# EasyEDA Pro project 智能车.eprj, board PCB5
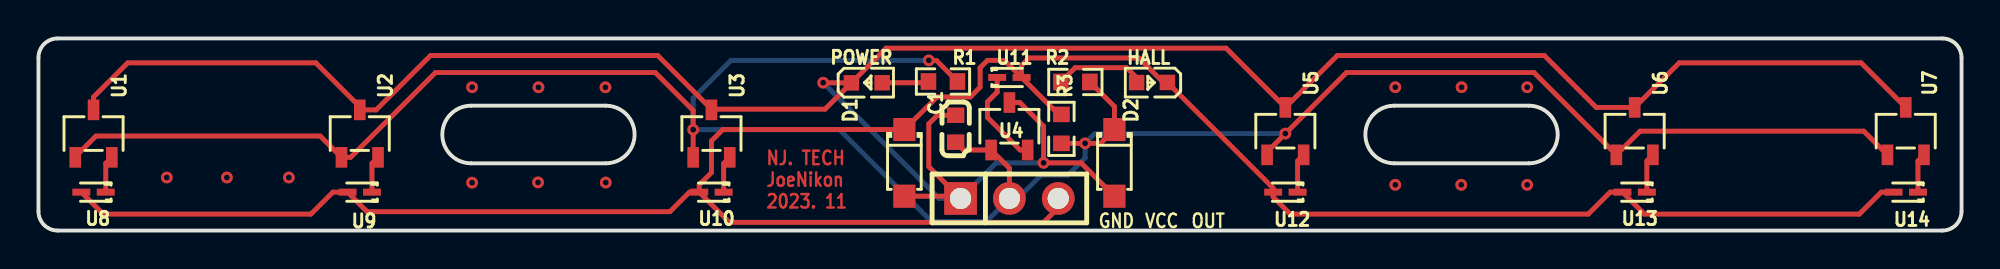
[diagram p16: board, top side]
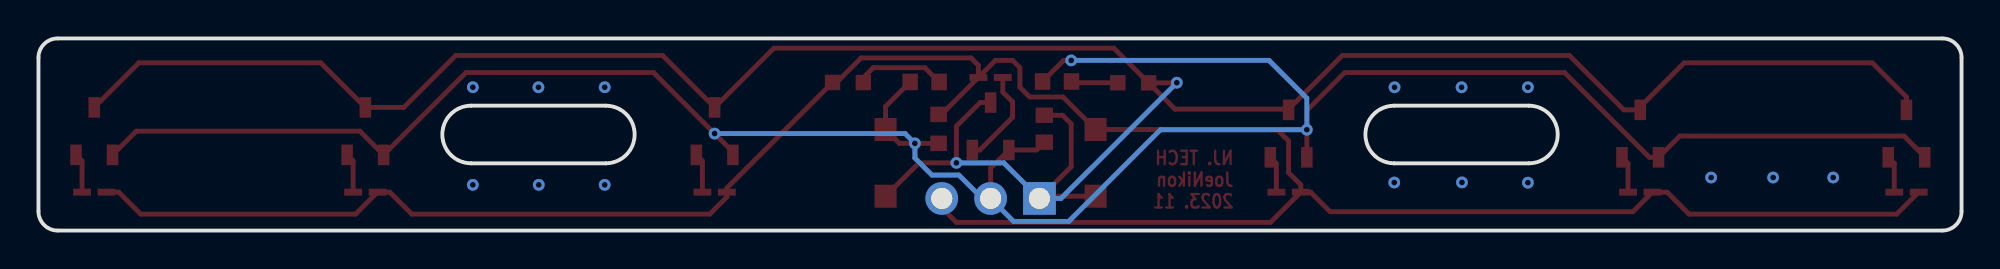
[diagram p17: board, bottom side, seen from below]

Outline 100 x 10 mm; copper layers: Top Layer, Bottom Layer. Coordinates in mm from the lower left corner of the outline.
Outline path: 0,9 0,1 arc(0.29,0.29) 1,0 99,0 arc(99.71,0.29) 100,1 100,9 arc(99.71,9.71) 99,10 1,10 arc(0.29,9.71) 0,9 ; 22.5,3.5 arc(21,5) 22.5,6.5 29.5,6.5 arc(31,5) 29.5,3.5 22.5,3.5 ; 70.5,6.5 77.5,6.5 arc(79,5) 77.5,3.5 70.5,3.5 arc(69,5) 70.5,6.5
Stack: Top Layer 0.035mm / Dielectric1 1.51mm FR4 er 4.5 / Bottom Layer 0.035mm

## Design rules (mm)
template: JLCPCB Capability(Two Layers Board)
spacing copperThickness1oz (default): track to track 0.102, other pairs 0.152 to 0.3
spacing copperThickness2oz: track to track 0.203, other pairs 0.152 to 0.3
track width copperThickness1oz (default): min 0.127, default 0.254, max 2.54
track width copperThickness2oz: min 0.203, default 0.254, max 2.54
differential pair differentialPair (default): width min 0.127, default 0.254, max 2.54; gap min 0.152, default 0.152
via viaSize (default): diameter min 0.5, default 0.61, max 10; hole min 0.3, default 0.305, max 6.3

## Placement (name value [footprint] x y rotation side)
C1  100nF  [C0603]  47.69 5.3 90 top
D1  SMF5.0A  [SOD-123FL_L2.7-W1.8-LS3.7-RD]  45.03 3.52 270 top
D2  SMF5.0A  [SOD-123FL_L2.7-W1.8-LS3.7-RD]  55.95 3.52 270 top
H1  -  [HDR-TH_3P-P2.54-V-M]  50.49 1.67 0 top
HALL  -  [LED_0603]  57.85 7.7 180 top
POWER  -  [LED_0603]  43.12 7.7 0 top
R1  4.7K  [R0603]  47.03 7.76 0 top
R2  4.7K  [R0603]  53.92 7.73 0 top
R3  10K  [R0603]  53.19 5.29 270 top
U1  DH553  [SOT-23-3_L2.9-W1.6-P1.90-LS2.8-BR]  2.86 5.05 270 top
U2  DH553  [SOT-23-3_L2.9-W1.6-P1.90-LS2.8-BR]  16.71 5.05 270 top
U3  DH553  [SOT-23-3_L2.9-W1.6-P1.90-LS2.8-BR]  35 5.05 270 top
U4  DH553  [SOT-23-3_L2.9-W1.6-P1.90-LS2.8-BR]  50.49 5.43 270 top
U5  DH553  [SOT-23-3_L2.9-W1.6-P1.90-LS2.8-BR]  64.84 5.17 270 top
U6  DH553  [SOT-23-3_L2.9-W1.6-P1.90-LS2.8-BR]  83 5.17 270 top
U7  DH553  [SOT-23-3_L2.9-W1.6-P1.90-LS2.8-BR]  97.1 5.17 270 top
U8  RB521S-30  [SOD-523_L1.2-W0.8-LS1.6-RD]  2.86 2 180 top
U9  RB521S-30  [SOD-523_L1.2-W0.8-LS1.6-RD]  16.71 2 180 top
U10  RB521S-30  [SOD-523_L1.2-W0.8-LS1.6-RD]  35 2 180 top
U11  RB521S-30  [SOD-523_L1.2-W0.8-LS1.6-RD]  50.49 7.97 0 top
U12  RB521S-30  [SOD-523_L1.2-W0.8-LS1.6-RD]  64.84 2 180 top
U13  RB521S-30  [SOD-523_L1.2-W0.8-LS1.6-RD]  83 2 180 top
U14  RB521S-30  [SOD-523_L1.2-W0.8-LS1.6-RD]  97.1 2 180 top

## Footprints (pads in the part's own frame, mm; a bottom-side part is the same pattern mirrored in y, then rotated)
C0603
  rect 0.8x0.9 smd: 1(-0.7,0) 2(0.7,0)
HDR-TH_3P-P2.54-V-M
  rect 1.7x1.7 hole 1.1: 1(-2.54,0)
  round 1.7 hole 1.1: 2(0,0) 3(2.54,0)
LED_0603
  rect 0.8x0.8 smd: 1(-0.851,-0.01) 2(0.75,-0.005)
R0603
  rect 0.806x0.864 smd: 1(-0.753,0) 2(0.753,0)
SOD-123FL_L2.7-W1.8-LS3.7-RD
  rect 1.2x1.15 smd: 1(-1.735,0) 2(1.735,0)
SOD-523_L1.2-W0.8-LS1.6-RD
  rect 0.93x0.36 smd: 1(-0.635,0) 2(0.635,0)
SOT-23-3_L2.9-W1.6-P1.90-LS2.8-BR
  rect 1.07x0.6 smd: 1(1.235,-0.95) 2(1.235,0.95) 3(-1.235,0)

## Nets
As in the schematic.

## Via types
v1: diameter 0.61, hole 0.305, Top Layer to Bottom Layer, 21 vias

## Routing (per net, layer and track width the routed paths; a pad name or vN(x,y) marks a point on that pad's centre or on a via; arc(x,y) is an arc through that point)
GND: length 139.6
  Top Layer w0.254: D2.2 54.22,3.52 v1(52.27,3.52) 52.27,5.43 51.03,6.66 U4.3 ; 35,6.32 32.2,9.11 20.39,9.11 17.56,6.28 U2.3 16.71,6.44 14.42,8.73 4.64,8.73 2.86,6.95 U1.3 ; 35,6.32 40.9,6.32 POWER.1 ; 35,6.32 U3.3 ; POWER.1 40.81,7.69 v1(40.81,7.7) ; POWER.1 44.08,9.49 61.76,9.49 U5.3 67.54,9.11 78.3,9.11 81,6.41 U6.3 85.32,8.73 94.78,8.73 U7.3 ; C1.2 46.74,6 46.3,5.56 46.3,3.32 47.83,1.79 ; 47.83,1.79 H1.1 ; 47.83,1.79 D1.2
  Bottom Layer w0.254: v1(52.27,3.52) 49.8,3.52 H1.1 46.83,1.67 v1(40.81,7.7)
  vias: v1(6.67,2.76) v1(9.8,2.76) v1(13.02,2.76) v1(22.55,7.46) v1(22.55,2.49) v1(26,7.46) v1(25.98,2.51) v1(29.48,7.46) v1(29.5,2.5) v1(70.56,7.46) v1(70.56,2.38) v1(74,7.46) v1(73.98,2.38) v1(77.41,7.46) v1(77.41,2.38)
VCC: length 137.8
  Top Layer w0.254: U1.1 1.91,3.84 2.99,4.92 14.65,4.92 U2.1 16.23,3.81 20.64,8.22 32.07,8.22 34.04,6.25 v1(34.04,5.25) U3.1 ; U5.1 63.89,4.1 v1(64.84,5.05) 68.02,8.22 77.77,8.22 U6.1 83.29,5.17 94.91,5.17 U7.1 ; v1(46.3,8.86) 46.69,8.86 R1.2 ; R3.2 v1(54.43,4.54) 55.23,4.54 D2.1 55.95,6.46 R2.2 ; H1.2 50.49,3.24 U4.1 48.1,4.19 C1.1
  Bottom Layer w0.254: v1(64.84,5.05) 54.93,5.05 v1(54.43,4.54) 54.43,3.78 53.54,2.89 52.14,2.89 50.92,1.67 H1.2 49.29,0.48 46.43,0.48 41.65,5.25 v1(34.04,5.25) 34.04,6.89 36.01,8.86 v1(46.3,8.86)
HALL: length 129.9
  Top Layer w0.254: R3.1 53.05,6.05 U11.2 ; U14.2 95.83,2 94.69,0.86 83.51,0.86 U13.2 81.73,2 80.59,0.86 65.09,0.86 64.21,1.75 U12.2 64.21,2.21 HALL.1 58.5,7.71 57.22,8.98 51.5,8.98 51.12,8.6 U11.2 ; U11.2 50.24,8.86 49.35,8.86 48.97,8.48 48.97,7.46 48.46,6.95 46.72,6.95 D1.1 35.59,5.26 35,4.67 35,3.02 34.36,2.38 U10.2 ; U10.2 33.85,2 32.84,0.98 17.09,0.98 U9.2 15.31,2 14.17,0.86 3.37,0.86 U8.2 ; U10.2 35.93,0.43 52.27,0.43 53.03,1.19 H1.3
$1N449: length 1.9
  Top Layer w0.254: U1.2 3.5,3.5 U8.1
$1N481: length 1.9
  Top Layer w0.254: 17.66,3.81 17.34,3.5 U9.1
$1N513: length 1.9
  Top Layer w0.254: U10.1 35.63,3.5 U3.2
$1N545: length 5.1
  Top Layer w0.254: U4.2 51.04,4.19 49.35,5.89 49.35,6.7 49.85,7.21 U11.1
$1N577: length 2.1
  Top Layer w0.254: U5.2 65.47,3.62 U12.1
$1N609: length 2.1
  Top Layer w0.254: U13.1 83.64,3.62 U6.2
$1N641: length 2.1
  Top Layer w0.254: U14.1 97.73,3.62 U7.2
$1N1073: length 2.4
  Top Layer w0.254: R1.1 46.22,7.69 POWER.2
$1N1125: length 4.7
  Top Layer w0.254: R2.1 53.91,8.48 56.59,8.48 57.11,7.96 HALL.2

## Copper pours and planes (outline as drawn; the poured copper is in the pictures)
GND on Top Layer: -3.49,12.67 102.81,12.67 102.81,-5.87 -3.49,-5.87
GND on Bottom Layer: -28.63,23.21 86.18,23.21 86.18,-7.53 -28.63,-7.53

## Text on the board
Top Layer: NJ. TECH / JoeNikon / 2023. 11
Top Silkscreen Layer: GND | VCC | OUT
